# EasyEDA Pro project wukong01-Y003-HTOL.eprj, board PCB1 (continued)
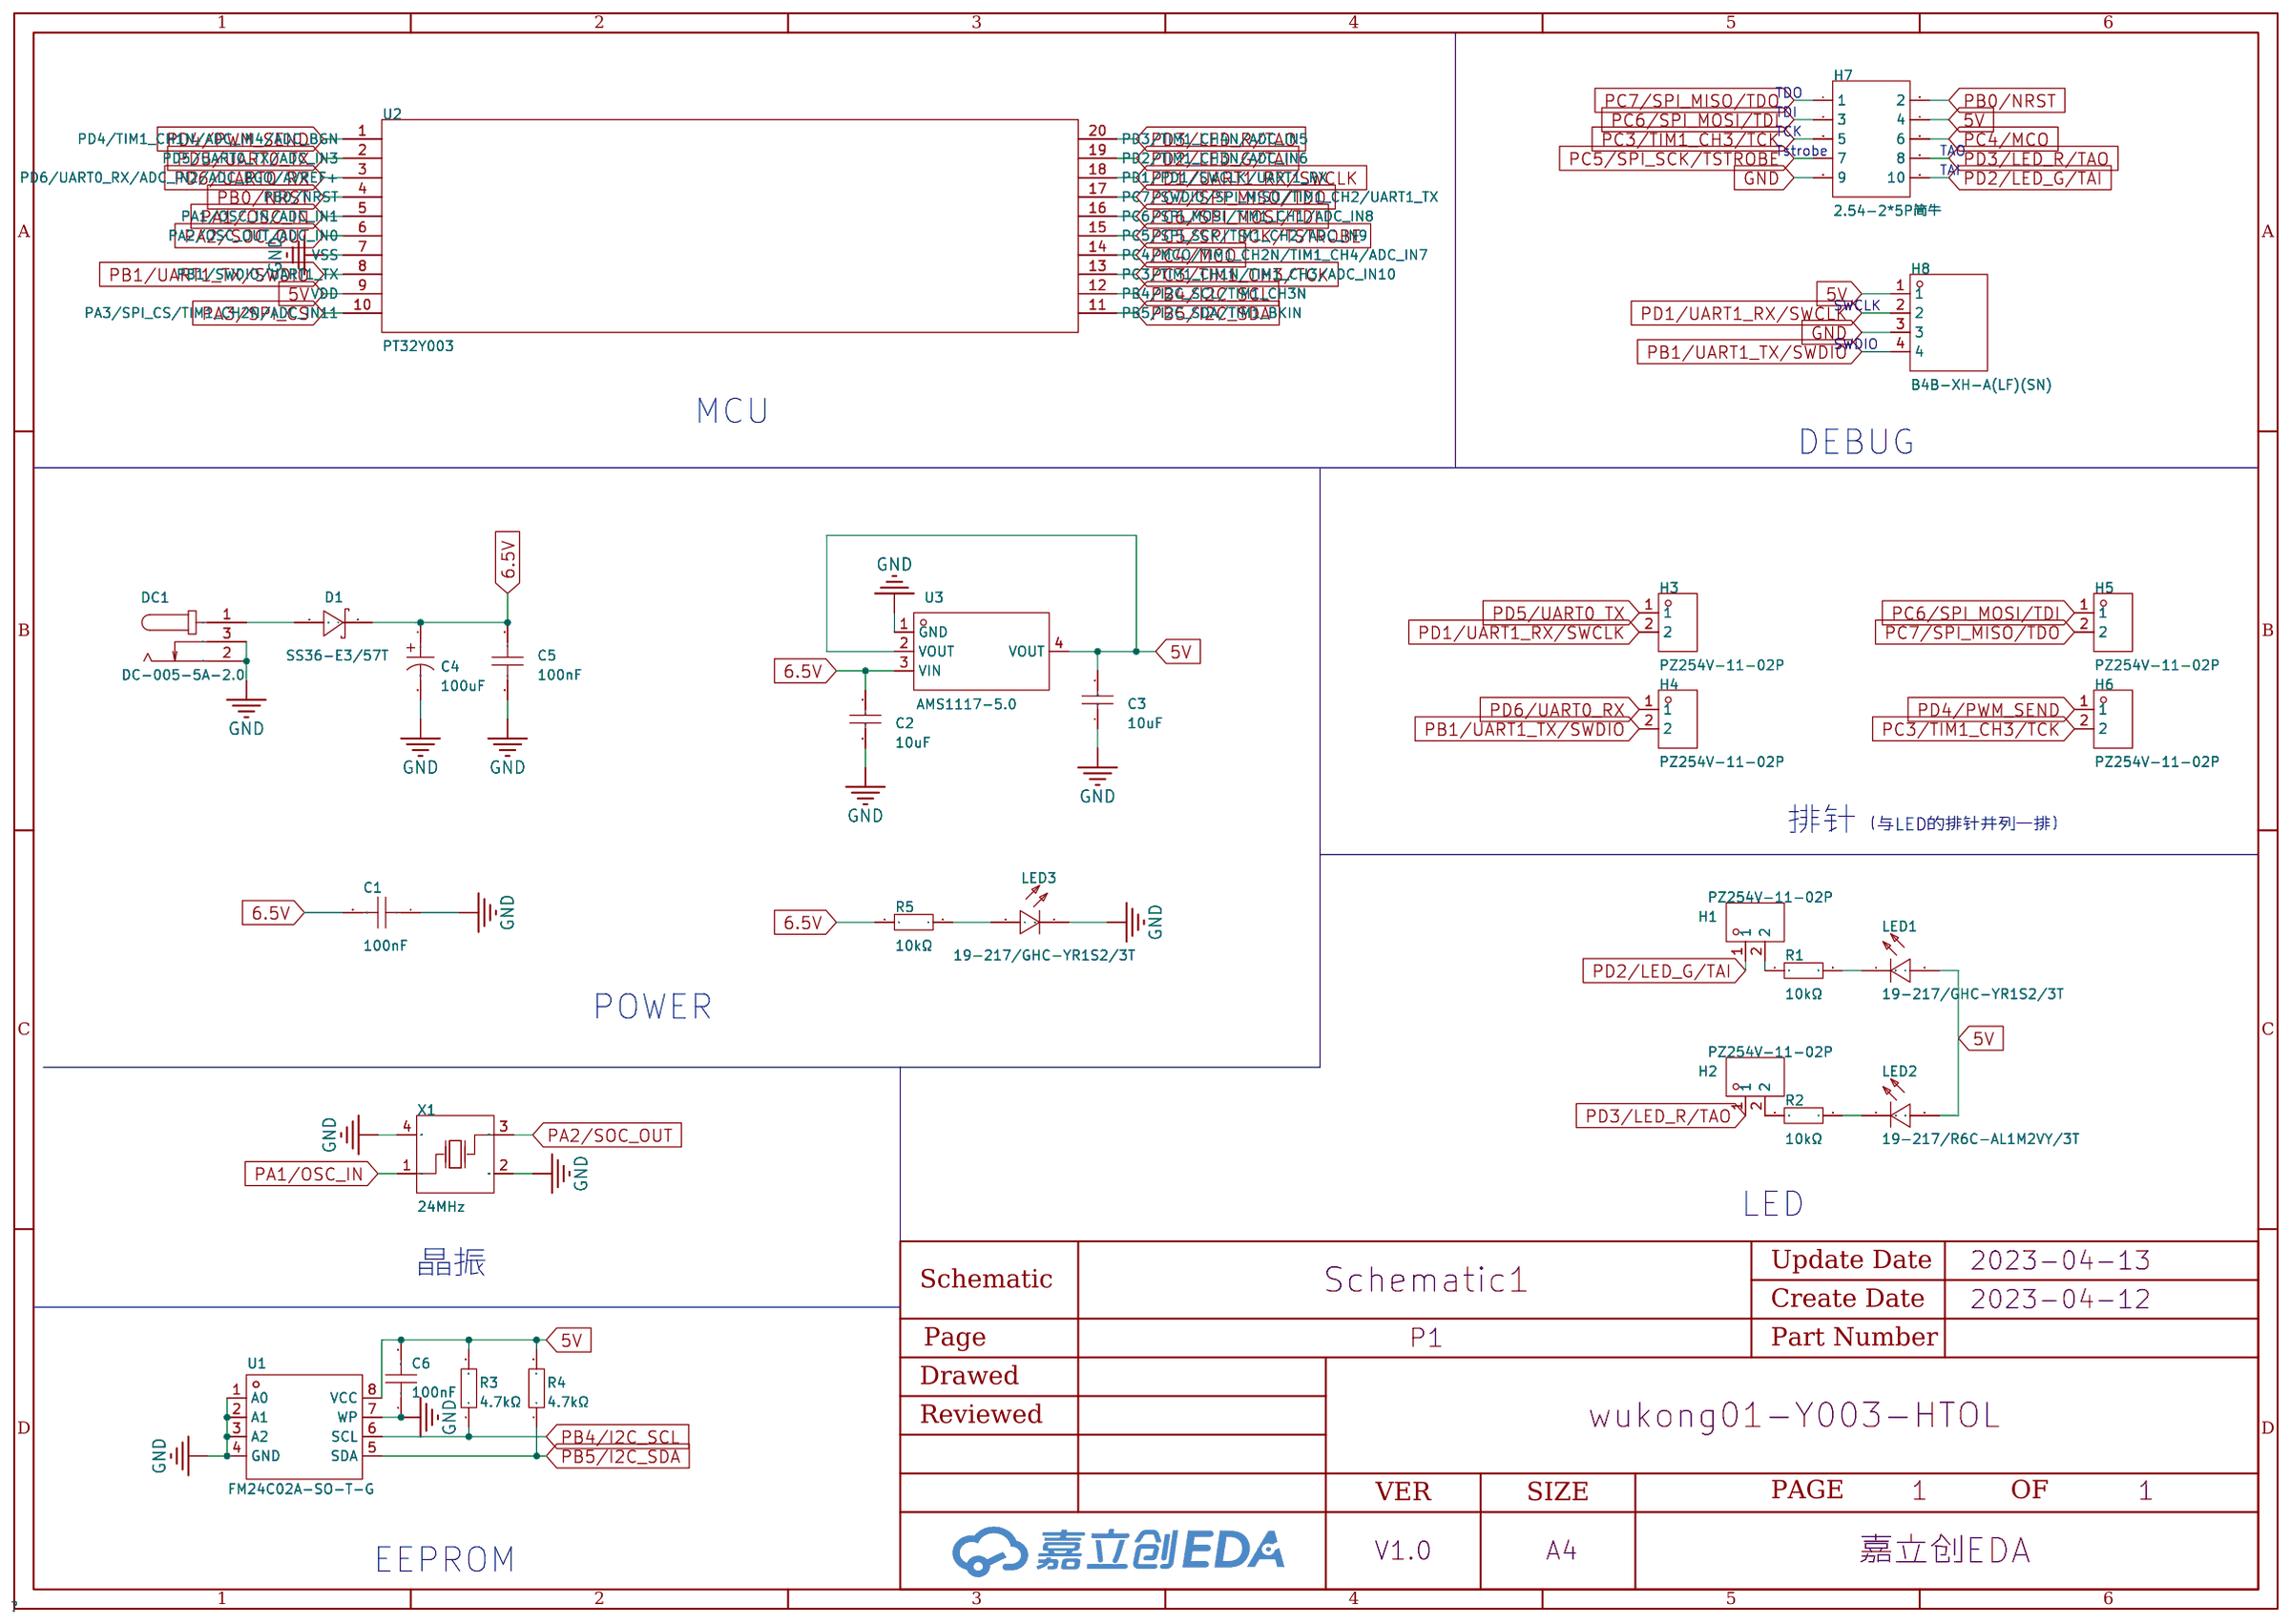
[diagram p0: schematic sheet]
## Routing (per net, layer and track width the routed paths; a pad name or vN(x,y) marks a point on that pad's centre or on a via; arc(x,y) is an arc through that point) (continued)
  Bottom Layer w0.254: v1(138.43,101.47) 138.43,93.98 139.83,92.58 149.35,92.58 150.75,93.98 v1(150.75,106.93) H3#3.2 ; H8#2.2 178.82,127.64 v1(199.77,127.64) ; v1(52.7,127.64) 31.75,127.64 H8#6.2 ; H3#23.2 v1(101.73,21.08) 101.73,8.13 100.33,6.73 90.8,6.73 89.41,8.13 v1(89.41,15.62) ; H3#26.2 v1(101.73,235.71) 101.73,222.76 100.33,221.36 90.8,221.36 89.41,222.76 v1(89.41,230.25) ; H3#29.2 v1(297.82,235.71) 297.82,222.76 296.42,221.36 286.89,221.36 285.5,222.76 v1(285.5,230.25) ; H3#34.2 v1(248.79,192.79) 248.79,179.83 247.4,178.44 237.87,178.44 236.47,179.83 v1(236.47,187.33) ; v1(101.73,170.56) 80.77,170.56 H8#35.2 ; H3#2.2 v1(199.77,106.93) 199.77,93.98 198.37,92.58 188.85,92.58 187.45,93.98 v1(187.45,101.47) ; v1(89.41,144.4) 89.41,136.91 90.8,135.51 100.33,135.51 101.73,136.91 v1(101.73,149.86) H3#38.2 ; H3#20.2 v1(248.79,64.01) 248.79,51.05 247.4,49.66 237.87,49.66 236.47,51.05 v1(236.47,58.55) ; v1(150.75,256.41) 129.79,256.41 H8#25.2 ; v1(101.73,84.71) 80.77,84.71 H8#12.2 ; H8#4.2 276.86,127.64 v1(297.82,127.64) ; v1(285.5,58.55) 285.5,51.05 286.89,49.66 296.42,49.66 297.82,51.05 v1(297.82,64.01) H3#19.2 ; H8#14.2 276.86,84.71 v1(297.82,84.71) ; H8#38.2 276.86,170.56 v1(297.82,170.56) ; v1(150.75,170.56) 129.79,170.56 H8#37.2 ; v1(101.73,127.64) 80.77,127.64 H8.2 ; H3#13.2 v1(52.7,64.01) 52.7,51.05 51.31,49.66 41.78,49.66 40.39,51.05 v1(40.39,58.55) ; v1(297.82,256.41) 276.86,256.41 H8#26.2 ; H3#35.2 v1(297.82,192.79) 297.82,179.83 296.42,178.44 286.89,178.44 285.5,179.83 v1(285.5,187.33) ; H8#20.2 129.79,41.78 v1(150.75,41.78) ; v1(187.45,144.4) 187.45,136.91 188.85,135.51 198.37,135.51 199.77,136.91 v1(199.77,149.86) H3#36.2 ; H8#11.2 31.75,84.71 v1(52.7,84.71) ; H3#4.2 v1(101.73,106.93) 101.73,93.98 100.33,92.58 90.8,92.58 89.41,93.98 v1(89.41,101.47) ; v1(248.79,299.34) 227.84,299.34 H8#15.2 ; v1(150.75,213.49) 129.79,213.49 H8#31.2 ; v1(138.43,58.55) 138.43,51.05 139.83,49.66 149.35,49.66 150.75,51.05 v1(150.75,64.01) H3#14.2 ; H8#22.2 227.84,84.71 v1(248.79,84.71) ; v1(187.45,15.62) 187.45,8.13 188.85,6.73 198.37,6.73 199.77,8.13 v1(199.77,21.08) H3#16.2 ; H8#24.2 178.82,256.41 v1(199.77,256.41) ; H8#29.2 80.77,213.49 v1(101.73,213.49) ; v1(285.5,101.47) 285.5,93.98 286.89,92.58 296.42,92.58 297.82,93.98 v1(297.82,106.93) H3#7.2 ; v1(248.79,41.78) 227.84,41.78 H8#21.2 ; v1(236.47,101.47) 236.47,93.98 237.87,92.58 247.4,92.58 248.79,93.98 v1(248.79,106.93) H3#6.2 ; v1(150.75,84.71) 129.79,84.71 H8#18.2 ; H3#28.2 v1(248.79,235.71) 248.79,222.76 247.4,221.36 237.87,221.36 236.47,222.76 v1(236.47,230.25) ; H8#5.2 227.84,127.64 v1(248.79,127.64) ; v1(199.77,299.34) 178.82,299.34 H8#8.2 ; v1(40.39,144.4) 40.39,136.91 41.78,135.51 51.31,135.51 52.7,136.91 v1(52.7,149.86) H3#39.2 ; v1(199.77,170.56) 178.82,170.56 H8#36.2 ; v1(89.41,273.18) 89.41,265.68 90.8,264.29 100.33,264.29 101.73,265.68 v1(101.73,278.64) H3#8.2 ; v1(199.77,84.71) 178.82,84.71 H8#13.2 ; v1(40.39,15.62) 40.39,8.13 41.78,6.73 51.31,6.73 52.7,8.13 v1(52.7,21.08) H3#17.2 ; H3#27.2 v1(52.7,235.71) 52.7,222.76 51.31,221.36 41.78,221.36 40.39,222.76 v1(40.39,230.25) ; H3#24.2 v1(199.77,235.71) 199.77,222.76 198.37,221.36 188.85,221.36 187.45,222.76 v1(187.45,230.25) ; v1(248.79,213.49) 227.84,213.49 H8#33.2 ; H3#15.2 v1(199.77,64.01) 199.77,51.05 198.37,49.66 188.85,49.66 187.45,51.05 v1(187.45,58.55) ; v1(236.47,144.4) 236.47,136.91 237.87,135.51 247.4,135.51 248.79,136.91 v1(248.79,149.86) H3#40.2 ; v1(199.77,213.49) 178.82,213.49 H8#30.2 ; H8#32.2 276.86,213.49 v1(297.82,213.49) ; H3#30.2 v1(199.77,192.79) 199.77,179.83 198.37,178.44 188.85,178.44 187.45,179.83 v1(187.45,187.33) ; H3#9.2 v1(199.77,278.64) 199.77,265.68 198.37,264.29 188.85,264.29 187.45,265.68 v1(187.45,273.18) ; v1(52.7,170.56) 31.75,170.56 H8#40.2 ; v1(138.43,144.4) 138.43,136.91 139.83,135.51 149.35,135.51 150.75,136.91 v1(150.75,149.86) H3#37.2 ; H8#9.2 129.79,299.34 v1(150.75,299.34) ; H3#5.2 v1(52.7,106.93) 52.7,93.98 51.31,92.58 41.78,92.58 40.39,93.98 v1(40.39,101.47) ; v1(236.47,273.18) 236.47,265.68 237.87,264.29 247.4,264.29 248.79,265.68 v1(248.79,278.64) H3#12.2 ; v1(297.82,299.34) 276.86,299.34 H8#10.2 ; H3#32.2 v1(101.73,192.79) 101.73,179.83 100.33,178.44 90.8,178.44 89.41,179.83 v1(89.41,187.33) ; H3#18.2 v1(150.75,21.08) 150.75,8.13 149.35,6.73 139.83,6.73 138.43,8.13 v1(138.43,15.62) ; v1(285.5,144.4) 285.5,136.91 286.89,135.51 296.42,135.51 297.82,136.91 v1(297.82,149.86) H3.2 ; v1(52.7,256.41) 31.75,256.41 H8#28.2 ; H8#23.2 80.77,256.41 v1(101.73,256.41) ; H8#16.2 80.77,41.78 v1(101.73,41.78) ; v1(248.79,170.56) 227.84,170.56 H8#39.2 ; v1(150.75,127.64) 129.79,127.64 H8#3.2 ; v1(236.47,15.62) 236.47,8.13 237.87,6.73 247.4,6.73 248.79,8.13 v1(248.79,21.08) H3#22.2 ; H3#33.2 v1(52.7,192.79) 52.7,179.83 51.31,178.44 41.78,178.44 40.39,179.83 v1(40.39,187.33) ; v1(101.73,299.34) 80.77,299.34 H8#7.2 ; v1(285.5,273.18) 285.5,265.68 286.89,264.29 296.42,264.29 297.82,265.68 v1(297.82,278.64) H3#11.2 ; H3#31.2 v1(150.75,192.79) 150.75,179.83 149.35,178.44 139.83,178.44 138.43,179.83 v1(138.43,187.33) ; H3#21.2 v1(101.73,64.01) 101.73,51.05 100.33,49.66 90.8,49.66 89.41,51.05 v1(89.41,58.55) ; v1(52.7,41.78) 31.75,41.78 H8#17.2 ; v1(52.7,213.49) 31.75,213.49 H8#34.2 ; H3#25.2 v1(150.75,235.71) 150.75,222.76 149.35,221.36 139.83,221.36 138.43,222.76 v1(138.43,230.25) ; H8#27.2 227.84,256.41 v1(248.79,256.41) ; H3#10.2 v1(150.75,278.64) 150.75,265.68 149.35,264.29 139.83,264.29 138.43,265.68 v1(138.43,273.18) ; H8#19.2 178.82,41.78 v1(199.77,41.78)
PD2/LED_G/TAI: length 1285.1
  Top Layer w0.254: 34.8,202.06 38.86,202.06 39.62,201.3 v1(39.62,194.82) ; 34.8,73.28 38.86,73.28 39.62,72.52 v1(39.62,66.04) ; H7#26.10 283.97,244.98 284.73,244.22 v1(284.73,237.74) ; U2#4.19 228.81,105.16 233.74,105.16 239.59,99.31 H1#6.1 ; 230.89,73.28 234.95,73.28 235.71,72.52 v1(235.71,66.04) ; U2#14.19 81.75,62.23 86.68,62.23 92.52,56.39 H1#15.1 ; H7#13.10 283.97,73.28 284.73,72.52 v1(284.73,66.04) ; H7#7.10 87.88,287.91 88.65,287.15 v1(88.65,280.67) ; H7#30.10 87.88,202.06 88.65,201.3 v1(88.65,194.82) ; H1#17.1 190.56,56.39 184.72,62.23 179.79,62.23 U2#7.19 ; H7#29.10 136.91,202.06 137.67,201.3 v1(137.67,194.82) ; v1(235.71,23.11) 235.71,29.59 234.95,30.35 230.89,30.35 ; H1#8.1 141.54,99.31 135.7,105.16 130.77,105.16 130.76,105.15 ; v1(137.67,66.04) 137.67,72.52 136.91,73.28 H7#17.10 ; H1#12.1 141.54,271.02 135.7,276.86 130.77,276.86 130.76,276.85 ; H1#3.1 288.61,142.24 282.77,148.08 277.84,148.08 U2#37.19 ; v1(137.67,108.97) 137.67,115.44 136.91,116.21 H7.10 ; H1#37.1 288.61,185.17 282.77,191.01 277.84,191.01 U2#31.19 ; 34.8,116.21 38.86,116.21 39.62,115.44 v1(39.62,108.97) ; H7#38.10 283.97,159.13 284.73,158.37 v1(284.73,151.89) ; U2#3.19 277.84,105.16 282.77,105.16 288.61,99.31 H1#9.1 ; v1(284.73,280.67) 284.73,287.15 283.97,287.91 H7#10.10 ; H1#26.1 190.56,228.09 184.72,233.93 179.79,233.93 U2#28.19 ; v1(235.71,194.82) 235.71,201.3 234.95,202.06 230.89,202.06 ; H7#32.10 283.97,202.06 284.73,201.3 v1(284.73,194.82) ; H1#38.1 190.56,142.24 184.72,148.08 179.79,148.08 U2#40.19 ; H1#14.1 43.5,56.39 37.66,62.23 32.73,62.23 U2#20.19 ; U2#26.19 228.81,233.93 233.74,233.93 239.59,228.09 H1#28.1 ; H7#15.10 87.88,73.28 88.65,72.52 v1(88.65,66.04) ; H7#31.10 185.93,202.06 186.69,201.3 v1(186.69,194.82) ; H7#3.10 185.93,116.21 186.69,115.44 v1(186.69,108.97) ; v1(186.69,280.67) 186.69,287.15 185.93,287.91 H7#8.10 ; U2#34.19 179.79,191.01 184.72,191.01 190.56,185.17 H1#32.1 ; 230.89,159.13 234.95,159.13 235.71,158.37 v1(235.71,151.89) ; v1(284.73,108.97) 284.73,115.44 283.97,116.21 H7#4.10 ; U2#10.19 179.79,276.86 184.72,276.86 190.56,271.02 H1#11.1 ; H1#24.1 141.54,56.39 135.7,62.23 130.77,62.23 130.76,62.22 ; v1(137.67,280.67) 137.67,287.15 136.91,287.91 H7#9.10 ; H7#35.10 136.91,159.13 137.67,158.37 v1(137.67,151.89) ; H7#36.10 87.88,159.13 88.65,158.37 v1(88.65,151.89) ; v1(186.69,237.74) 186.69,244.22 185.93,244.98 H7#25.10 ; H1#16.1 239.59,271.02 233.74,276.86 228.81,276.86 U2#16.19 ; H1#2.1 141.54,142.24 135.7,148.08 130.77,148.08 130.76,148.07 ; U2#17.19 179.79,19.3 184.72,19.3 190.56,13.46 H1#18.1 ; H1#36.1 141.54,185.17 135.7,191.01 130.77,191.01 130.76,191 ; H7#16.10 185.93,73.28 186.69,72.52 v1(186.69,66.04) ; 130.76,233.92 130.77,233.93 135.7,233.93 141.54,228.09 H1#30.1 ; U2#5.19 81.75,105.16 86.68,105.16 92.52,99.31 H1#5.1 ; U2#32.19 228.81,191.01 233.74,191.01 239.59,185.17 H1#34.1 ; v1(186.69,151.89) 186.69,158.37 185.93,159.13 H7#37.10 ; H1#10.1 92.52,271.02 86.68,276.86 81.75,276.86 U2#9.19 ; 34.8,159.13 38.86,159.13 39.62,158.37 v1(39.62,151.89) ; 130.76,19.29 130.77,19.3 135.7,19.3 141.54,13.46 H1#25.1 ; U2#22.19 32.73,19.3 37.66,19.3 43.5,13.46 H1#23.1 ; H1#19.1 239.59,56.39 233.74,62.23 228.81,62.23 U2#19.19 ; U2#12.19 277.84,62.23 282.77,62.23 288.61,56.39 H1#22.1 ; H1#33.1 92.52,185.17 86.68,191.01 81.75,191.01 U2#33.19 ; U2#13.19 277.84,276.86 282.77,276.86 288.61,271.02 H1#13.1 ; H1#29.1 43.5,228.09 37.66,233.93 32.73,233.93 U2#29.19 ; v1(88.65,108.97) 88.65,115.44 87.88,116.21 H7#2.10 ; 230.89,244.98 234.95,244.98 235.71,244.22 v1(235.71,237.74) ; U2#6.19 179.79,105.16 184.72,105.16 190.56,99.31 H1#4.1 ; U2.19 32.73,148.08 37.66,148.08 43.5,142.24 H1.1 ; v1(137.67,23.11) 137.67,29.59 136.91,30.35 H7#20.10 ; v1(39.62,237.74) 39.62,244.22 38.86,244.98 34.8,244.98 ; U2#23.19 81.75,19.3 86.68,19.3 92.52,13.46 H1#20.1 ; U2#27.19 81.75,233.93 86.68,233.93 92.52,228.09 H1#27.1 ; v1(186.69,23.11) 186.69,29.59 185.93,30.35 H7#21.10 ; v1(235.71,108.97) 235.71,115.44 234.95,116.21 230.89,116.21 ; H1#31.1 288.61,228.09 282.77,233.93 277.84,233.93 U2#25.19 ; U2#8.19 32.73,105.16 37.66,105.16 43.5,99.31 H1#7.1 ; U2#35.19 32.73,191.01 37.66,191.01 43.5,185.17 H1#35.1 ; 34.8,30.35 38.86,30.35 39.62,29.59 v1(39.62,23.11) ; H1#21.1 239.59,13.46 233.74,19.3 228.81,19.3 U2#21.19 ; v1(88.65,23.11) 88.65,29.59 87.88,30.35 H7#19.10 ; U2#38.19 228.81,148.08 233.74,148.08 239.59,142.24 H1#40.1 ; v1(137.67,237.74) 137.67,244.22 136.91,244.98 H7#23.10 ; H1#39.1 92.52,142.24 86.68,148.08 81.75,148.08 U2#39.19 ; v1(88.65,237.74) 88.65,244.22 87.88,244.98 H7#24.10 ; 230.89,287.91 234.95,287.91 235.71,287.15 v1(235.71,280.67)
  Bottom Layer w0.254: v1(88.65,274.96) v1(88.65,280.67) ; v1(284.73,232.03) v1(284.73,237.74) ; v1(39.62,232.03) v1(39.62,237.74) ; v1(235.71,17.4) v1(235.71,23.11) ; v1(88.65,232.03) v1(88.65,237.74) ; v1(284.73,146.18) v1(284.73,151.89) ; v1(186.69,146.18) v1(186.69,151.89) ; v1(235.71,146.18) v1(235.71,151.89) ; v1(88.65,17.4) v1(88.65,23.11) ; v1(39.62,60.33) v1(39.62,66.04) ; v1(284.73,274.96) v1(284.73,280.67) ; v1(39.62,103.25) v1(39.62,108.97) ; v1(39.62,17.4) v1(39.62,23.11) ; v1(137.67,189.1) v1(137.67,194.82) ; v1(235.71,232.03) v1(235.71,237.74) ; v1(88.65,146.18) v1(88.65,151.89) ; v1(39.62,189.1) v1(39.62,194.82) ; v1(235.71,60.33) v1(235.71,66.04) ; v1(137.67,17.4) v1(137.67,23.11) ; v1(235.71,103.25) v1(235.71,108.97) ; v1(88.65,189.1) v1(88.65,194.82) ; v1(186.69,189.1) v1(186.69,194.82) ; v1(137.67,60.33) v1(137.67,66.04) ; v1(186.69,103.25) v1(186.69,108.97) ; v1(88.65,60.33) v1(88.65,66.04) ; v1(137.67,103.25) v1(137.67,108.97) ; v1(235.71,274.96) v1(235.71,280.67) ; v1(284.73,103.25) v1(284.73,108.97) ; v1(137.67,232.03) v1(137.67,237.74) ; v1(186.69,232.03) v1(186.69,237.74) ; v1(186.69,17.4) v1(186.69,23.11) ; v1(39.62,146.18) v1(39.62,151.89) ; v1(235.71,189.1) v1(235.71,194.82) ; v1(284.73,189.1) v1(284.73,194.82) ; v1(137.67,146.18) v1(137.67,151.89) ; v1(88.65,103.25) v1(88.65,108.97) ; v1(186.69,60.33) v1(186.69,66.04) ; v1(137.67,274.96) v1(137.67,280.67) ; v1(186.69,274.96) v1(186.69,280.67) ; v1(284.73,60.33) v1(284.73,66.04)
PD3/LED_R/TAO: length 1520.9
  Top Layer w0.254: U2#25.20 277.83,234.57 283.34,234.57 v1(285.88,232.03) 287.27,230.63 H2#30.1 ; H2#5.1 91.19,101.85 v1(89.79,103.25) 87.25,105.79 81.74,105.79 U2#5.20 ; H7#18.8 228.35,31.5 228.85,32 236.09,32 236.85,31.24 v1(236.85,23.11) ; U2#23.20 81.74,19.94 87.25,19.94 v1(89.79,17.4) 91.19,16 H2#24.1 ; H7#12.8 32.26,74.42 32.77,74.93 40.01,74.93 40.77,74.17 v1(40.77,66.04) ; v1(89.79,237.74) 89.79,245.87 89.03,246.63 81.79,246.63 81.28,246.13 H7#24.8 ; H2#31.1 189.23,187.71 v1(187.83,189.1) 185.29,191.64 179.79,191.64 U2#34.20 ; v1(187.83,194.82) 187.83,202.95 187.07,203.71 179.83,203.71 179.32,203.2 179.32,202.06 ; v1(236.85,280.67) 236.85,288.8 236.09,289.56 228.85,289.56 228.35,289.05 H7#14.8 ; H2#23.1 287.27,58.93 v1(285.88,60.33) 283.34,62.87 277.83,62.87 U2#12.20 ; H7#7.8 81.28,289.05 81.79,289.56 89.03,289.56 89.79,288.8 v1(89.79,280.67) ; 179.32,159.13 179.32,160.27 179.83,160.78 187.07,160.78 187.83,160.02 v1(187.83,151.89) ; v1(89.79,151.89) 89.79,160.02 89.03,160.78 81.79,160.78 81.28,160.27 H7#36.8 ; H2#28.1 42.16,230.63 v1(40.77,232.03) 38.23,234.57 32.72,234.57 U2#29.20 ; U2#9.20 81.74,277.5 87.25,277.5 v1(89.79,274.96) 91.19,273.56 H2#9.1 ; H7#26.8 277.37,246.13 277.88,246.63 285.12,246.63 285.88,245.87 v1(285.88,237.74) ; 130.76,234.57 130.76,234.57 136.27,234.57 v1(138.81,232.03) 140.21,230.63 H2#29.1 ; v1(40.77,23.11) 40.77,31.24 40.01,32 32.77,32 32.26,31.5 H7#11.8 ; H2#16.1 189.23,16 v1(187.83,17.4) 185.29,19.94 179.79,19.94 U2#17.20 ; U2#4.20 228.81,105.79 234.31,105.79 v1(236.85,103.25) 238.25,101.85 H2#4.1 ; H7#33.8 228.35,203.2 228.85,203.71 236.09,203.71 236.85,202.95 v1(236.85,194.82) ; H2#26.1 238.25,230.63 v1(236.85,232.03) 234.31,234.57 228.81,234.57 U2#26.20 ; U2#7.20 179.79,62.87 185.29,62.87 v1(187.83,60.33) 189.23,58.93 H2#15.1 ; v1(187.83,237.74) 187.83,245.87 187.07,246.63 179.83,246.63 179.32,246.13 179.32,244.98 ; v1(138.81,280.67) 138.81,288.8 138.05,289.56 130.81,289.56 130.3,289.05 130.3,287.91 ; H7#15.8 81.28,74.42 81.79,74.93 89.03,74.93 89.79,74.17 v1(89.79,66.04) ; 130.76,191.65 130.76,191.64 136.27,191.64 v1(138.81,189.1) 140.21,187.71 H2#35.1 ; 228.8,148.72 228.81,148.72 234.31,148.72 v1(236.85,146.18) 238.25,144.78 H2#38.1 ; U2#33.20 81.74,191.64 87.25,191.64 v1(89.79,189.1) 91.19,187.71 H2#33.1 ; v1(285.88,151.89) 285.88,160.02 285.12,160.78 277.88,160.78 277.37,160.27 H7#38.8 ; 130.3,244.98 130.3,246.13 130.81,246.63 138.05,246.63 138.81,245.87 v1(138.81,237.74) ; v1(89.79,108.97) 89.79,117.09 89.03,117.86 81.79,117.86 81.28,117.35 H7#2.8 ; v1(285.88,66.04) 285.88,74.17 285.12,74.93 277.88,74.93 277.37,74.42 H7#13.8 ; v1(138.81,108.97) 138.81,117.09 138.05,117.86 130.81,117.86 130.3,117.35 130.3,116.21 ; H2#3.1 189.23,101.85 v1(187.83,103.25) 185.29,105.79 179.79,105.79 U2#6.20 ; H7#32.8 277.37,203.2 277.88,203.71 285.12,203.71 285.88,202.95 v1(285.88,194.82) ; v1(187.83,280.67) 187.83,288.8 187.07,289.56 179.83,289.56 179.32,289.05 179.32,287.91 ; 179.32,30.35 179.32,31.5 179.83,32 187.07,32 187.83,31.24 v1(187.83,23.11) ; v1(89.79,194.82) 89.79,202.95 89.03,203.71 81.79,203.71 81.28,203.2 H7#30.8 ; 130.3,30.35 130.3,31.5 130.81,32 138.05,32 138.81,31.24 v1(138.81,23.11) ; H2#14.1 238.25,273.56 v1(236.85,274.96) 234.31,277.5 228.81,277.5 U2#16.20 ; H7#4.8 277.37,117.35 277.88,117.86 285.12,117.86 285.88,117.09 v1(285.88,108.97) ; H2#36.1 287.27,187.71 v1(285.88,189.1) 283.34,191.64 277.83,191.64 U2#31.20 ; U2#22.20 32.72,19.94 38.23,19.94 v1(40.77,17.4) 42.16,16 H2#20.1 ; 130.76,148.72 130.76,148.72 136.27,148.72 v1(138.81,146.18) 140.21,144.78 H2.1 ; H2#40.1 42.16,144.78 v1(40.77,146.18) 38.23,148.72 32.72,148.72 32.72,148.72 ; U2#32.20 228.81,191.64 234.31,191.64 v1(236.85,189.1) 238.25,187.71 H2#32.1 ; H2#22.1 238.25,16 v1(236.85,17.4) 234.31,19.94 228.81,19.94 U2#21.20 ; v1(187.83,108.97) 187.83,117.09 187.07,117.86 179.83,117.86 179.32,117.35 179.32,116.21 ; v1(236.85,237.74) 236.85,245.87 236.09,246.63 228.85,246.63 228.35,246.13 H7#27.8 ; H2#27.1 91.19,230.63 v1(89.79,232.03) 87.25,234.57 81.74,234.57 U2#27.20 ; U2#13.20 277.83,277.5 283.34,277.5 v1(285.88,274.96) 287.27,273.56 H2#12.1 ; H2#21.1 140.21,58.93 v1(138.81,60.33) 136.27,62.87 130.76,62.87 130.76,62.87 ; 130.3,159.13 130.3,160.27 130.81,160.78 138.05,160.78 138.81,160.02 v1(138.81,151.89) ; v1(89.79,23.11) 89.79,31.24 89.03,32 81.79,32 81.28,31.5 H7#19.8 ; H7#22.8 228.35,74.42 228.85,74.93 236.09,74.93 236.85,74.17 v1(236.85,66.04) ; H2#19.1 140.21,16 v1(138.81,17.4) 136.27,19.94 130.76,19.94 130.76,19.94 ; H7#40.8 32.26,160.27 32.77,160.78 40.01,160.78 40.77,160.02 v1(40.77,151.89) ; U2#28.20 179.79,234.57 185.29,234.57 v1(187.83,232.03) 189.23,230.63 H2#25.1 ; v1(138.81,194.82) 138.81,202.95 138.05,203.71 130.81,203.71 130.3,203.2 130.3,202.06 ; 130.3,73.28 130.3,74.42 130.81,74.93 138.05,74.93 138.81,74.17 v1(138.81,66.04) ; U2#19.20 228.81,62.87 234.31,62.87 v1(236.85,60.33) 238.25,58.93 H2#17.1 ; H2#8.1 287.27,101.85 v1(285.88,103.25) 283.34,105.79 277.83,105.79 U2#3.20 ; H7#5.8 228.35,117.35 228.85,117.86 236.09,117.86 236.85,117.09 v1(236.85,108.97) ; H7#28.8 32.26,246.13 32.77,246.63 40.01,246.63 40.77,245.87 v1(40.77,237.74) ; U2#35.20 32.72,191.64 38.23,191.64 v1(40.77,189.1) 42.16,187.71 H2#34.1 ; 179.32,73.28 179.32,74.42 179.83,74.93 187.07,74.93 187.83,74.17 v1(187.83,66.04) ; v1(236.85,151.89) 236.85,160.02 236.09,160.78 228.85,160.78 228.35,160.27 H7#39.8 ; v1(285.88,280.67) 285.88,288.8 285.12,289.56 277.88,289.56 277.37,289.05 H7#10.8 ; H2#37.1 189.23,144.78 v1(187.83,146.18) 185.29,148.72 179.79,148.72 179.78,148.72 ; H2#2.1 287.27,144.78 v1(285.88,146.18) 283.34,148.72 277.83,148.72 277.83,148.72 ; H2#11.1 140.21,273.56 v1(138.81,274.96) 136.27,277.5 130.76,277.5 130.76,277.5 ; H7#34.8 32.26,203.2 32.77,203.71 40.01,203.71 40.77,202.95 v1(40.77,194.82) ; H2#13.1 42.16,58.93 v1(40.77,60.33) 38.23,62.87 32.72,62.87 U2#20.20 ; U2#14.20 81.74,62.87 87.25,62.87 v1(89.79,60.33) 91.19,58.93 H2#18.1 ; H7#6.8 32.26,117.35 32.77,117.86 40.01,117.86 40.77,117.09 v1(40.77,108.97) ; U2#8.20 32.72,105.79 38.23,105.79 v1(40.77,103.25) 42.16,101.85 H2#6.1 ; H2#39.1 91.19,144.78 v1(89.79,146.18) 87.25,148.72 81.74,148.72 81.74,148.72 ; U2#10.20 179.79,277.5 185.29,277.5 v1(187.83,274.96) 189.23,273.56 H2#10.1 ; 130.76,105.8 130.76,105.79 136.27,105.79 v1(138.81,103.25) 140.21,101.85 H2#7.1
  Bottom Layer w0.254: v1(40.77,103.25) v1(40.77,108.97) ; v1(285.88,146.18) v1(285.88,151.89) ; v1(89.79,232.03) v1(89.79,237.74) ; v1(236.85,146.18) v1(236.85,151.89) ; v1(138.81,146.18) v1(138.81,151.89) ; v1(236.85,274.96) v1(236.85,280.67) ; v1(187.83,189.1) v1(187.83,194.82) ; v1(285.88,103.25) v1(285.88,108.97) ; v1(285.88,60.33) v1(285.88,66.04) ; v1(187.83,103.25) v1(187.83,108.97) ; v1(187.83,60.33) v1(187.83,66.04) ; v1(187.83,274.96) v1(187.83,280.67) ; v1(40.77,232.03) v1(40.77,237.74) ; v1(89.79,103.25) v1(89.79,108.97) ; v1(285.88,274.96) v1(285.88,280.67) ; v1(187.83,232.03) v1(187.83,237.74) ; v1(236.85,103.25) v1(236.85,108.97) ; v1(89.79,60.33) v1(89.79,66.04) ; v1(40.77,146.18) v1(40.77,151.89) ; v1(40.77,60.33) v1(40.77,66.04) ; v1(138.81,60.33) v1(138.81,66.04) ; v1(187.83,146.18) v1(187.83,151.89) ; v1(138.81,232.03) v1(138.81,237.74) ; v1(138.81,189.1) v1(138.81,194.82) ; v1(40.77,189.1) v1(40.77,194.82) ; v1(236.85,189.1) v1(236.85,194.82) ; v1(187.83,17.4) v1(187.83,23.11) ; v1(236.85,17.4) v1(236.85,23.11) ; v1(138.81,274.96) v1(138.81,280.67) ; v1(138.81,17.4) v1(138.81,23.11) ; v1(285.88,189.1) v1(285.88,194.82) ; v1(40.77,17.4) v1(40.77,23.11) ; v1(285.88,232.03) v1(285.88,237.74) ; v1(236.85,232.03) v1(236.85,237.74) ; v1(89.79,189.1) v1(89.79,194.82) ; v1(89.79,17.4) v1(89.79,23.11) ; v1(89.79,146.18) v1(89.79,151.89) ; v1(236.85,60.33) v1(236.85,66.04) ; v1(138.81,103.25) v1(138.81,108.97) ; v1(89.79,274.96) v1(89.79,280.67)
PD4/PWM_SEND: length 962.6
  Top Layer w0.254: U2#21.1 221.1,19.94 220.85,20.19 220.85,20.57 221.11,20.83 234.31,20.83 236.6,18.54 H6#21.1 ; H6#10.1 138.56,276.1 136.27,278.38 123.06,278.38 122.81,278.13 122.81,277.75 123.06,277.5 U2#11.1 ; U2#10.1 172.08,277.5 171.83,277.75 171.83,278.13 172.09,278.38 185.29,278.38 187.58,276.1 H6#9.1 ; H6#7.1 285.62,104.39 283.34,106.68 270.13,106.68 269.88,106.43 269.88,106.05 270.12,105.8 U2#3.1 ; U2#7.1 172.08,62.87 171.83,63.12 171.83,63.5 172.09,63.75 185.29,63.75 187.58,61.47 H6#15.1 ; H6#19.1 138.56,18.54 136.27,20.83 123.06,20.83 122.81,20.57 122.81,20.19 123.06,19.94 U2#18.1 ; H6#39.1 40.51,147.32 38.23,149.61 25.02,149.61 24.77,149.35 24.77,148.97 25.02,148.72 26.97,148.72 ; H6#17.1 40.51,18.54 38.23,20.83 25.02,20.83 24.77,20.57 24.77,20.19 25.02,19.94 U2#22.1 ; 76,148.72 74.04,148.72 73.79,148.97 73.79,149.35 74.04,149.61 87.25,149.61 89.53,147.32 H6#38.1 ; H6#31.1 138.56,190.25 136.27,192.53 123.06,192.53 122.81,192.28 122.81,191.9 123.06,191.65 U2#30.1 ; H6#28.1 236.6,233.17 234.31,235.46 221.11,235.46 220.85,235.2 220.85,234.82 221.1,234.57 U2#26.1 ; U2#6.1 172.08,105.8 171.83,106.05 171.83,106.43 172.09,106.68 185.29,106.68 187.58,104.39 H6#2.1 ; U2#2.1 123.06,105.8 122.81,106.05 122.81,106.43 123.06,106.68 136.27,106.68 138.56,104.39 H6#3.1 ; H6#11.1 285.62,276.1 283.34,278.38 270.13,278.38 269.88,278.13 269.88,277.75 270.12,277.5 U2#13.1 ; H6#6.1 236.6,104.39 234.31,106.68 221.11,106.68 220.85,106.43 220.85,106.05 221.1,105.8 U2#4.1 ; U2#5.1 74.04,105.8 73.79,106.05 73.79,106.43 74.04,106.68 87.25,106.68 89.53,104.39 H6#4.1 ; U2#12.1 270.12,62.87 269.88,63.12 269.88,63.5 270.13,63.75 283.34,63.75 285.62,61.47 H6#22.1 ; U2#20.1 25.02,62.87 24.77,63.12 24.77,63.5 25.02,63.75 38.23,63.75 40.51,61.47 H6#13.1 ; H6#25.1 138.56,233.17 136.27,235.46 123.06,235.46 122.81,235.2 122.81,234.82 123.06,234.57 U2#24.1 ; 272.08,148.72 270.12,148.72 269.88,148.97 269.88,149.35 270.13,149.61 283.34,149.61 285.62,147.32 H6.1 ; U2#35.1 25.02,191.65 24.77,191.9 24.77,192.28 25.02,192.53 38.23,192.53 40.51,190.25 H6#33.1 ; H6#27.1 40.51,233.17 38.23,235.46 25.02,235.46 24.77,235.2 24.77,234.82 25.02,234.57 U2#29.1 ; U2#33.1 74.04,191.65 73.79,191.9 73.79,192.28 74.04,192.53 87.25,192.53 89.53,190.25 H6#32.1 ; H6#23.1 89.53,18.54 87.25,20.83 74.04,20.83 73.79,20.57 73.79,20.19 74.04,19.94 U2#23.1 ; U2#28.1 172.08,234.57 171.83,234.82 171.83,235.2 172.09,235.46 185.29,235.46 187.58,233.17 H6#24.1 ; U2#17.1 172.08,19.94 171.83,20.19 171.83,20.57 172.09,20.83 185.29,20.83 187.58,18.54 H6#16.1 ; H6#14.1 138.56,61.47 136.27,63.75 123.06,63.75 122.81,63.5 122.81,63.12 123.06,62.87 U2#15.1 ; U2#31.1 270.12,191.65 269.88,191.9 269.88,192.28 270.13,192.53 283.34,192.53 285.62,190.25 H6#35.1 ; H6#20.1 236.6,61.47 234.31,63.75 221.11,63.75 220.85,63.5 220.85,63.12 221.1,62.87 U2#19.1 ; H6#37.1 138.56,147.32 136.27,149.61 123.06,149.61 122.81,149.35 122.81,148.97 123.06,148.72 125.02,148.72 ; U2#14.1 74.04,62.87 73.79,63.12 73.79,63.5 74.04,63.75 87.25,63.75 89.53,61.47 H6#18.1 ; U2#25.1 270.12,234.57 269.88,234.82 269.88,235.2 270.13,235.46 283.34,235.46 285.62,233.17 H6#29.1 ; 174.04,148.72 172.08,148.72 171.83,148.97 171.83,149.35 172.09,149.61 185.29,149.61 187.58,147.32 H6#36.1 ; U2#27.1 74.04,234.57 73.79,234.82 73.79,235.2 74.04,235.46 87.25,235.46 89.53,233.17 H6#26.1 ; U2#16.1 221.1,277.5 220.85,277.75 220.85,278.13 221.11,278.38 234.31,278.38 236.6,276.1 H6#12.1 ; 223.06,148.72 221.1,148.72 220.85,148.97 220.85,149.35 221.11,149.61 234.31,149.61 236.6,147.32 H6#40.1 ; U2#32.1 221.1,191.65 220.85,191.9 220.85,192.28 221.11,192.53 234.31,192.53 236.6,190.25 H6#34.1 ; U2#8.1 25.02,105.8 24.77,106.05 24.77,106.43 25.02,106.68 38.23,106.68 40.51,104.39 H6#5.1 ; U2#9.1 74.04,277.5 73.79,277.75 73.79,278.13 74.04,278.38 87.25,278.38 89.53,276.1 H6#8.1 ; H6#30.1 187.58,190.25 185.29,192.53 172.09,192.53 171.83,192.28 171.83,191.9 172.08,191.65 U2#34.1
